# EasyEDA Pro project Cerberus_Sub_Controller_v02.eprj, board Cerberus_Sub_Controller_v02 (continued)
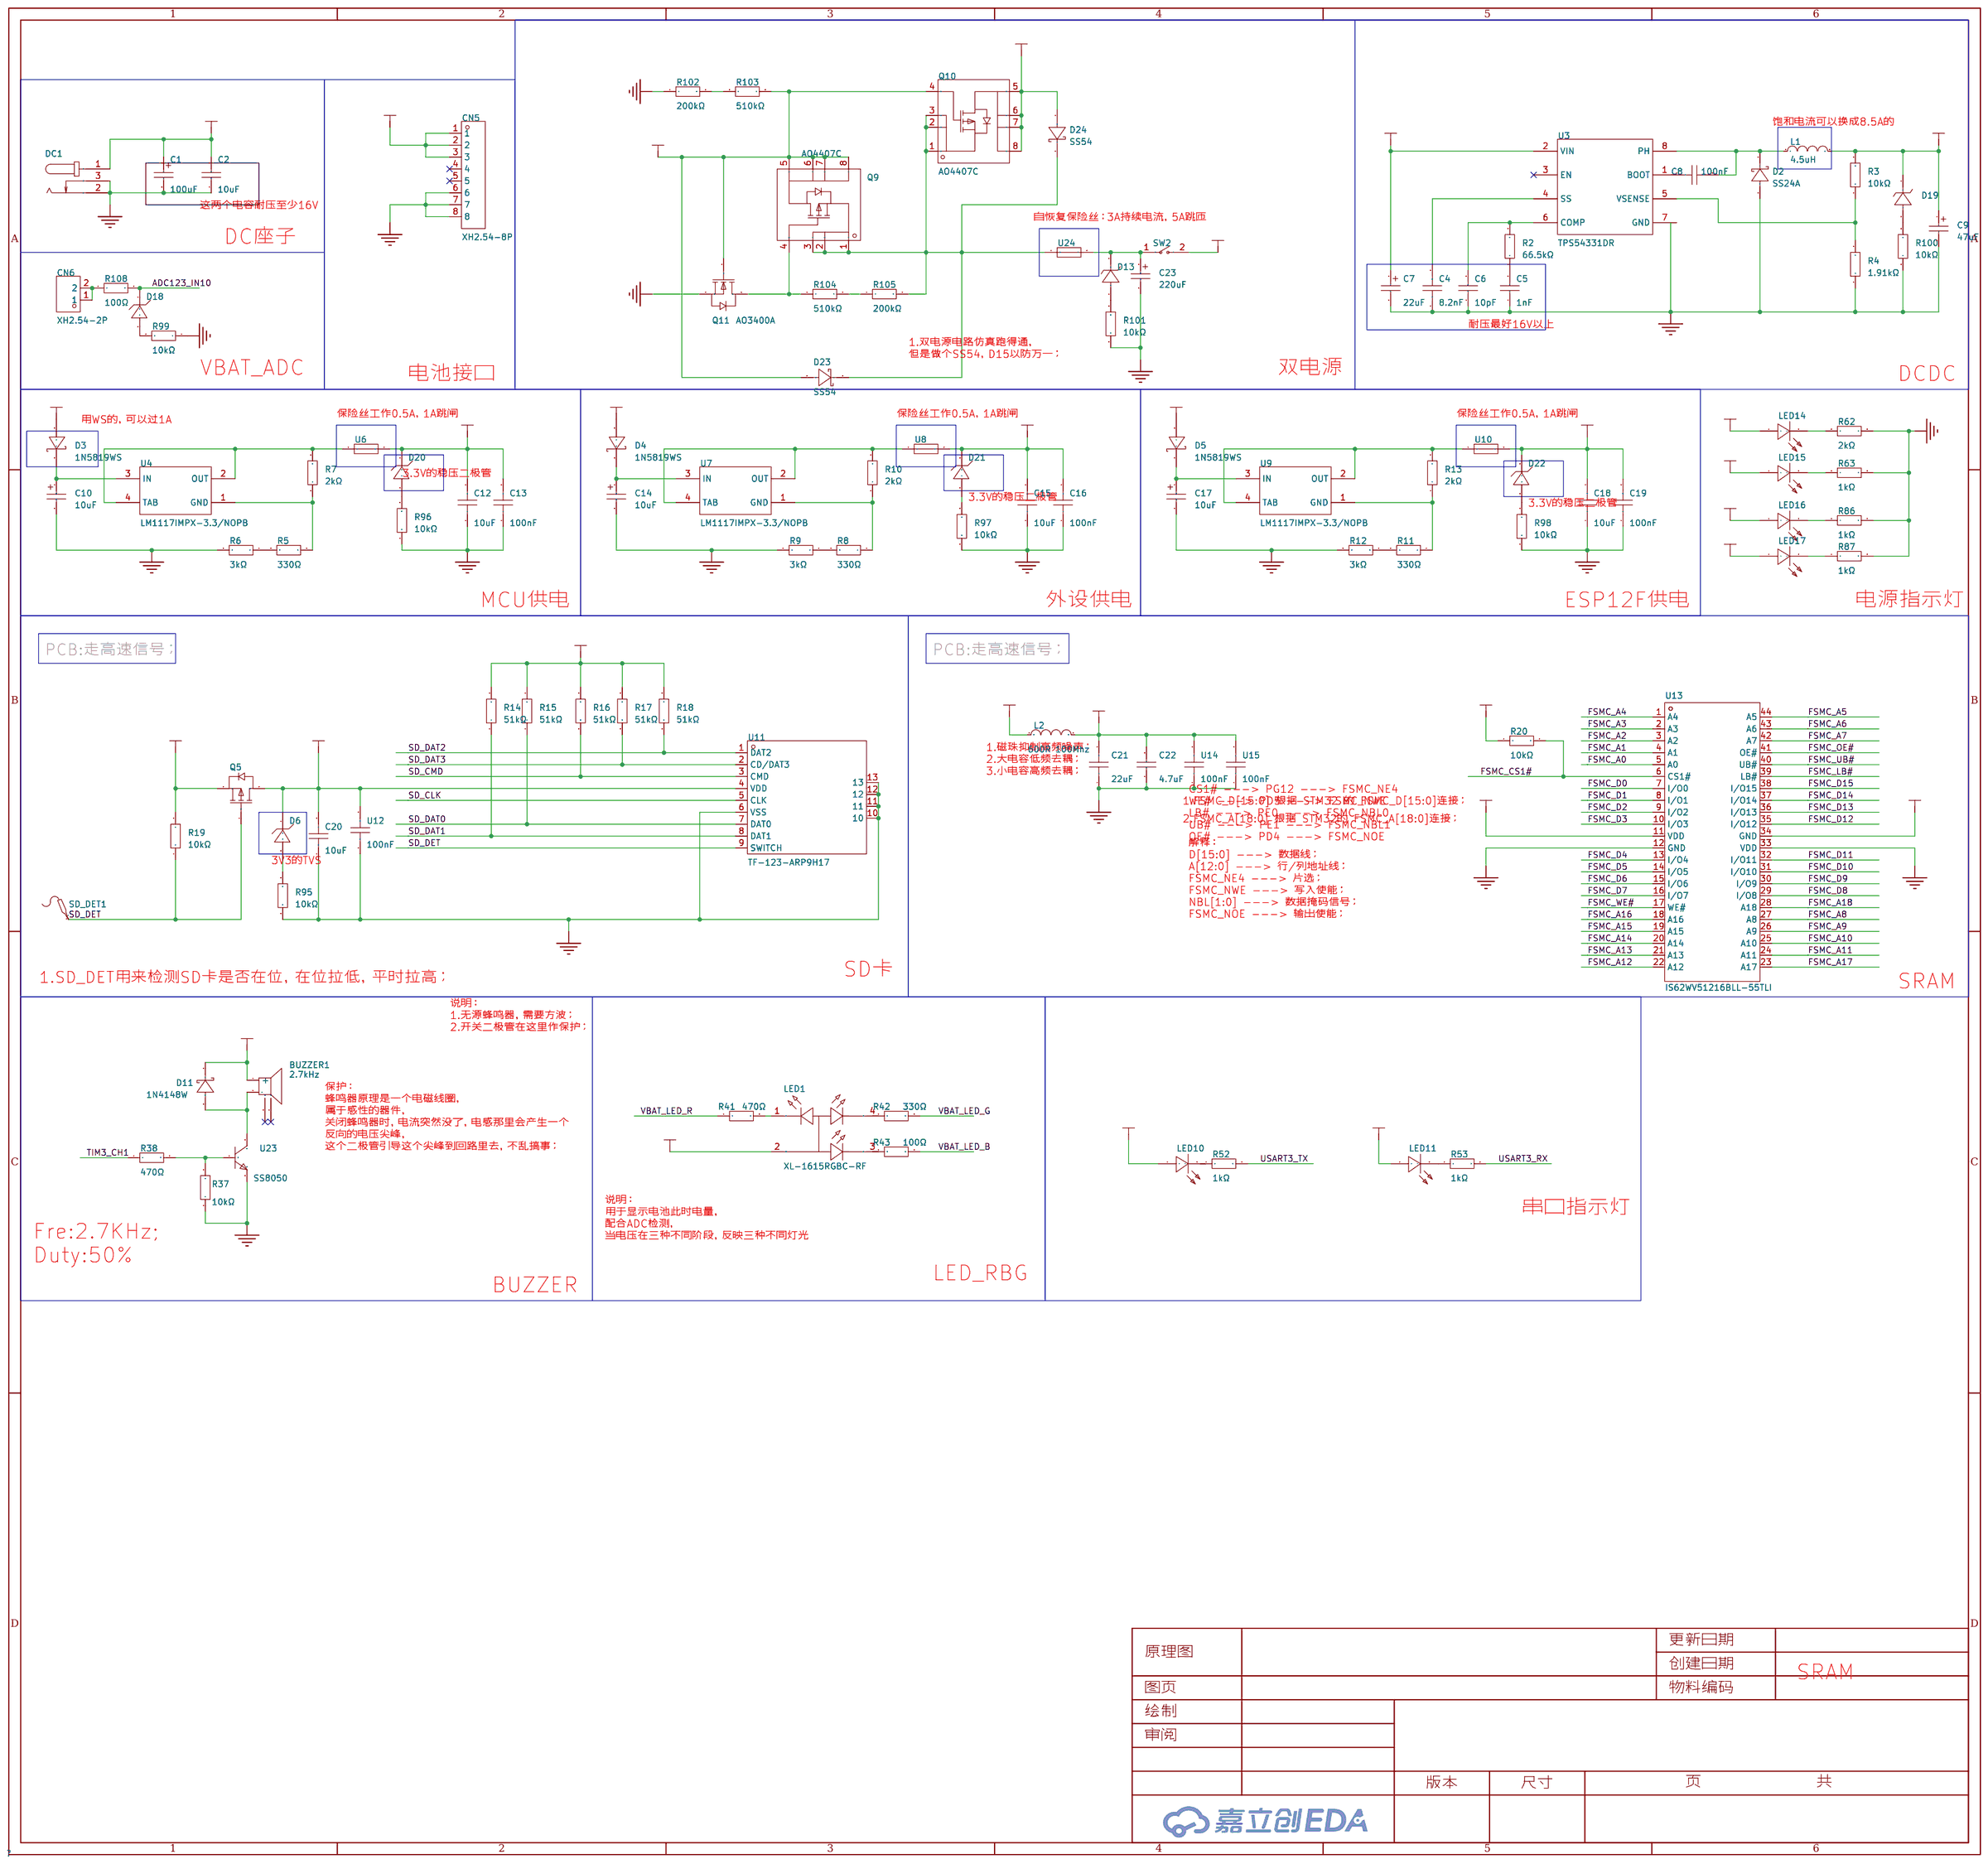
[diagram p0: A1]
## Footprints (pads in the part's own frame, mm; a bottom-side part is the same pattern mirrored in y, then rotated) (continued)
  rect 1.4x1.2 smd: 1(-1.1,-0.875) 2(1.1,-0.875) 3(1.1,0.875) 4(-1.1,0.875)
QFN-24_L4.0-W4.0-P0.50-BL-EP2.7
  oval 0.28x0.8 smd: 1(-1.25,-2) 2(-0.75,-2) 3(-0.25,-2) 4(0.25,-2) 5(0.75,-2) 6(1.25,-2) 13(1.25,2) 14(0.75,2) 15(0.25,2) 16(-0.25,2) 17(-0.75,2) 18(-1.242,2)
  oval 0.8x0.28 smd: 7(2,-1.25) 8(2,-0.75) 9(2,-0.25) 10(2,0.25) 11(2,0.75) 12(2,1.25) 19(-2,1.25) 20(-2,0.75) 21(-2,0.25) 22(-2,-0.25) 23(-2,-0.75) 24(-2,-1.25)
  rect 2.7x2.7 smd: 25(0.013,0)
R0402
  rect 0.566x0.54 smd: 1(-0.433,0) 2(0.433,0)
R0603
  rect 0.806x0.864 smd: 1(-0.753,0) 2(0.753,0)
SMA_L4.3-W2.6-LS5.0-FD
  rect 2.046x1.62 smd: 1(-2.304,-0.009) 2(2.304,0.009)
SMA_L4.4-W2.6-LS5.1-FD
  rect 2x1.62 smd: 1(-2.2,0) 2(2.2,0)
SOD-123_L2.7-W1.6-LS3.7-FD
  rect 0.88x0.96 smd: 1(-1.61,0) 2(1.61,0)
SOD-323_L1.6-W1.3-LS2.7-RD
  rect 0.9x0.7 smd: 1(-1.3,0) 2(1.3,0)
SOD-323_L1.7-W1.3-LS2.6-RD
  rect 0.83x0.63 smd: 1(-1.14,0) 2(1.14,0)
SOD-323_L1.8-W1.3-LS2.5-RD
  rect 1x0.75 smd: 1(-1.173,0) 2(1.173,0)
SOIC-8_L5.0-W4.0-P1.27-LS6.0-BL
  oval 0.569x1.95 smd: 1(-1.905,-2.705) 2(-0.635,-2.705) 3(0.635,-2.705) 4(1.905,-2.705) 5(1.905,2.705) 6(0.635,2.705) 7(-0.635,2.705) 8(-1.905,2.705)
SOP-8_L4.9-W3.9-P1.27-LS6.0-BL
  oval 0.63x1.865 smd: 1(-1.905,-2.683) 2(-0.635,-2.683) 3(0.635,-2.683) 4(1.905,-2.683) 5(1.905,2.683) 6(0.635,2.683) 7(-0.635,2.683) 8(-1.905,2.683)
SOT-23-3_L2.9-W1.3-P1.90-LS2.4-BR
  rect 1.25x0.7 smd: 1(1,-0.95) 2(1,0.95) 3(-1,0)
SOT-223_L6.5-W3.5-P2.30-LS7.0-BR
  rect 2.465x1.05 smd: 1(2.857,-2.3) 2(2.857,0) 3(2.857,2.3)
  rect 2.465x3.54 smd: 4(-2.857,0)
SW-SMD_4P-L4.5-W4.5-P3.00-LS7.0
  rect 1.4x0.9 smd: 1(-3.4,1.5) 2(3.4,1.5) 3(-3.4,-1.5) 4(3.4,-1.5)
SW-SMD_L3.9-W3.0-P4.45
  rect 1.23x1.36 smd: 1(-2.185,0) 2(2.185,0)
SW-TH_2P-L15.0-W10.5-P5.00_KCD11-2P-R
  oval 1.6x5 hole 0.8x4: 1(-2.5,0) 2(2.5,0)
Test-Point-0.5mm
  round 1.27 smd far side: 1(0,0)
TF-SMD_TF-123-ARP9H15
  rect 0.5x1 smd: 1(3.85,-3.092) 2(2.75,-3.092) 3(1.65,-3.092) 4(0.9,-3.092) 5(-0.55,-3.092) 6(-1.65,-3.092) 7(-2.75,-3.092) 8(-3.85,-3.092) 9(0.2,-3.092)
  rect 1.3x1.4 smd: 10(-5.1,-1.357) 11(-5.1,3.092) 12(5.1,3.092) 13(5.1,-1.357)
TSOP-44_L18.4-W10.2-P0.80-LS11.8-BL
  oval 0.448x1.551 smd: 1(-8.4,-5.655) 2(-7.6,-5.655) 3(-6.8,-5.655) 4(-6,-5.655) 5(-5.2,-5.655) 6(-4.4,-5.655) 7(-3.6,-5.655) 8(-2.8,-5.655) 9(-2,-5.655) 10(-1.2,-5.655) 11(-0.4,-5.655) 12(0.4,-5.655) 13(1.2,-5.655) 14(2,-5.655) 15(2.8,-5.655) 16(3.6,-5.655) 17(4.4,-5.655) 18(5.2,-5.655) 19(6,-5.655) 20(6.8,-5.655) 21(7.6,-5.655) 22(8.4,-5.655) 23(8.4,5.655) 24(7.6,5.655) 25(6.8,5.655) 26(6,5.655) 27(5.2,5.655) 28(4.4,5.655) 29(3.6,5.655) 30(2.8,5.655) 31(2,5.655) 32(1.2,5.655) 33(0.4,5.655) 34(-0.4,5.655) 35(-1.2,5.655) 36(-2,5.655) 37(-2.8,5.655) 38(-3.6,5.655) 39(-4.4,5.655) 40(-5.2,5.655) 41(-6,5.655) 42(-6.8,5.655) 43(-7.6,5.655) 44(-8.4,5.655)
USB-C-SMD_TYPE-C-6PIN-2MD-073
  rect 0.55x1.1 smd: 1(-3.2,2.375) 2(-2.4,2.375) 11(2.4,2.375) 12(3.2,2.375)
  rect 0.3x1.1 smd: 3(-1.75,2.375) 4(-1.25,2.375) 5(-0.75,2.375) 6(-0.25,2.375) 7(0.25,2.375) 8(0.75,2.375) 9(1.25,2.375) 10(1.75,2.375)
  oval 1.2x1.8 hole 0.6x1.2: 13(-4.325,-2.375) 14(4.325,-2.375)
  oval 1.1x2 hole 0.6x1.5: 13(-4.325,1.825) 14(4.325,1.825)
WIFIM-SMD_ESP-12F-ESP8266MOD
  rect 1.4x2.5 smd: 1(-7.651,-7.551) 2(-5.651,-7.551) 3(-3.651,-7.551) 4(-1.651,-7.551) 5(0.349,-7.551) 6(2.349,-7.551) 7(4.349,-7.551) 8(6.349,-7.551) 9(6.349,7.548) 10(4.349,7.55) 11(2.349,7.551) 12(0.349,7.551) 13(-1.651,7.55) 14(-3.651,7.551) 15(-5.651,7.551) 16(-7.651,7.551)
  rect 1.7x1.4 smd: 17(7.651,-5) 18(7.649,-3.002) 19(7.649,-1.004) 20(7.649,0.998) 21(7.649,2.997) 22(7.651,4.997)

## Nets
As in the schematic, except:
VCC_5V: +5V.1 C9.1 D3.2 D4.2 D5.2 D19.1 L1.2 R3.2 U22.1
VCC_7V4: 7V4.1 C7.1 SW2.2 U3.2
VCC_MCU_3V3: C3.2 C12.2 C13.2 C34.2 C35.2 C36.2 C37.2 C38.2 C39.2 C40.2 C41.2 C42.2 C43.2 C44.2 C45.2 C46.2 C47.2 C48.2 C49.2 C50.2 C51.2 C59.1 D20.1 H12.1 MCU_3V3#2.1 R39.2 R90.2 U6.2 U31.6 U31.17 U31.30 U31.32 U31.33 U31.39 U31.52 U31.62 U31.71 U31.72 U31.84 U31.95 U31.106 U31.108 U31.121 U31.131 U31.144
VCC_PER_3V3: Battery_led.2 BUZZER.1 C15.2 C16.2 C24.2 C25.1 C27.2 C28.1 C29.1 C31.1 CN3.1 D11.2 D21.1 L2.1 PER_3V3.1 Q5.2 R14.2 R15.2 R16.2 R17.2 R18.2 R19.2 R22.2 R24.2 R26.2 R27.2 R28.2 R70.2 R71.2 R89.1 RX3.1 TX3.1 U1.5 U1.8 U8.2 U16.8 U16.13 U17.9 U17.10 U20.2 U21.2
BOOT0: BOOT0.1 U31.138
ESP_IO0: C52.1 ESP_IO0.1 R80.1 U30.12
ESP_RST: C53.1 ESP_RST.1 R83.1 U30.1
MPU6050_INT: MPU_INT.1 R67.1 U31.22
NRST: 32_NRST.1 C58.1 H12.2 R89.2 U31.25
$1N9180: BUZZER.2 D11.1 U23.3
$1N9349: Battery_led.1 R41.2
$1N9353: Battery_led.3 R43.1
$1N9484: Battery_led.4 R42.1
$1N10259: R52.1 TX3.2
$1N10263: R53.1 RX3.2
$1N12165: 7V4.2 R62.1
$1N12423: +5V.2 R63.1
$1N13016: PER_3V3.2 R86.1
$1N13023: MCU_3V3#2.2 R87.1
$2N7340: C52.2 ESP_IO0.4 R81.2
$2N7398: C53.2 ESP_RST.4 R84.2
$3N7064: MCU_3V3.1 R90.1
$3N7085: GND.1 R91.2
$3N7148: 32_NRST.2 C58.2 R106.1

Pads without a net: BUZZER 3 4; CN3 6; CN5 4 5; ESP_IO0 2 3; ESP_RST 2 3; U1 4; U3 3; U16 2 3 4 5 14 15 16 17 19 21 22; U17 2 11 12; U30 2 4 11 13 14 17 18 19 20 21 22; U31 1 2 3 4 5 7 18 19 20 21 27 28 29 40 41 43 44 45 46 47 49 74 75 76 91 92 97 100 103 110 117 122 123 124 126 128 132 134 136 137; USB1 2 3 9 11

## Via types
v1: diameter 0.45, hole 0.3, Top Layer to Bottom Layer, 1410 vias
v2: diameter 0.61, hole 0.305, Top Layer to Bottom Layer, 38 vias

## Routing (per net, layer and track width the routed paths; a pad name or vN(x,y) marks a point on that pad's centre or on a via; arc(x,y) is an arc through that point)
GND: length 51
  Top Layer w0.203: v1(40.77,43.95) 40.85,44.03 40.85,44.89 U31.16 ; v1(46.99,58.3) 47.57,57.72 47.57,57.11 46.62,56.16 ; v1(26.67,66.36) 26.67,66.14 U31.83 ; 19.68,56.16 18.29,57.55 v1(18.29,57.79) ; U31.61 39.37,65.17 v1(39.37,65.79) ; U31.120 24.26,50.06 v1(24.26,50.42) ; 45.21,51.14 46.1,50.24 v1(46.1,49.79) ; U31.51 43.05,61.79 v1(43.05,62.23) ; U31.130 25.53,44.26 v1(25.53,44.07) ; v1(23.37,62.23) 23.37,61.66 U31.94
  Top Layer w0.254: 43.69,46.23 arc(43.73,46.26) v1(43.75,46.21) arc(43.74,45.57) 43.56,44.96 arc(43.28,44.68) v1(43.04,44.37) arc(42.73,43.8) 42.54,43.18 arc(42.53,43.03) v1(42.56,42.89) arc(42.61,42.77) 42.67,42.68 arc(43.18,42.09) v1(43.72,41.54) arc(44.14,41.15) 44.58,40.77 arc(44.86,40.56) v1(45.16,40.39) arc(46,40.07) v1(46.89,39.98) arc(47.87,40.15) v1(48.76,40.59) arc(48.96,40.74) 49.15,40.9 arc(49.57,41.29) v1(49.98,41.7) arc(50.57,42.32) v1(51.14,42.96) arc(51.29,43.13) 51.44,43.31 arc(51.74,43.78) v1(51.94,44.3) arc(51.99,45.22) v1(51.72,46.1) arc(51.65,46.23) 51.56,46.36 arc(51.14,46.88) v1(50.65,47.34) arc(50,47.8) 49.28,48.14 arc(48.51,48.28) v1(47.75,48.14) arc(47.49,48.03) 47.24,47.88 arc(46.86,47.65) v1(46.46,47.47) arc(45.84,47.3) v1(45.21,47.25)
  Bottom Layer w0.203: 18.05,13.85 v1(18.3,14.1) ; 18.05,13.85 18.04,13.84 U17.6 18.04,11.98 v1(17.74,11.69) ; 18.05,13.85 U17.8 ; U16.11 17.58,23.49 v1(17.7,23.37)
  vias: v1(0.76,91.74) v1(0.76,88.89) v1(0.76,86.17) v1(0.76,83.23) v1(0.76,80.38) v1(0.76,77.66) v1(0.76,74.88) v1(0.76,72.03) v1(0.76,69.31) v1(0.76,66.37) v1(0.76,63.52) v1(0.76,60.8) v1(0.76,57.74) v1(0.76,54.89) v1(0.76,52.17) v1(0.76,49.23) v1(0.76,46.38) v1(0.76,43.66) v1(0.76,40.86) v1(0.76,38.02) v1(0.76,35.3) v1(0.76,32.35) v1(0.76,29.5) v1(0.76,26.78) v1(0.76,23.31) v1(0.76,20.47) v1(0.76,17.75) v1(0.76,14.8) v1(0.76,11.96) v1(0.76,9.24) v1(0.76,6.89) v1(0.75,3.94) v1(1.52,93.49) v1(1.48,1.55) v1(2.11,59.59) v1(2.11,49.39) v1(2.8,71.63) v1(2.8,66.42) v1(3.05,18.16) v1(3.05,14.89) v1(3.05,11.56) v1(3.17,52.14) v1(3.33,0.77) v1(3.36,68.97) v1(3.4,50.3) v1(3.63,26.29) v1(3.68,85.22) v1(3.77,91.32) v1(3.91,62.36) v1(3.94,31.88) v1(3.94,30.48) v1(4.13,94.24) v1(4.32,56.39) v1(4.44,33.02) v1(4.57,58.81) v1(4.97,69.6) v1(4.97,68.4) v1(4.95,28.71) v1(5.08,52.14) v1(5.21,79.63) v1(5.21,77.47) v1(5.42,19.18) v1(5.46,5.97) v1(5.59,81.16) v1(5.84,41.79) v1(5.97,44.2) v1(6.22,39.27) v1(6.22,37.72) v1(6.17,0.77) v1(6.3,26.29) v1(6.48,75.82) v1(6.6,78.11) v1(6.56,59.59) v1(6.56,49.39) v1(6.82,72.17) v1(6.82,65.77) v1(6.87,6.85) v1(6.97,94.24) v1(6.98,79.76) v1(7.37,40.01) v1(7.37,36.71) v1(7.62,62.36) v1(7.75,91.32) v1(7.78,41.79) v1(7.87,85.6) v1(7.87,76.84) v1(7.87,44.2) v1(7.87,38.61) v1(8.13,74.17) v1(8.3,56.14) v1(8.51,78.36) v1(8.64,18.04) v1(8.64,14.86) v1(8.64,11.64) v1(8.59,6.85) v1(8.87,67.19) v1(8.89,0.77) v1(9.02,26.29) v1(9.14,39.75) v1(9.4,42.55) v1(9.53,75.31) v1(9.53,56.65) v1(9.53,51.19) v1(9.69,94.24) v1(9.75,36.71) v1(9.91,47.63) v1(9.86,44.2) v1(10.03,76.84) v1(10.16,40.77) v1(10.42,30.36) v1(10.41,29.09) v1(10.5,6.86) v1(10.54,3.94) v1(10.55,5.1) v1(10.67,74.17) v1(10.8,62.36) v1(10.8,33.41) v1(10.8,31.79) v1(10.92,66.52) v1(10.85,51.19) v1(10.92,48.64) v1(11.18,41.79) v1(11.3,59.32) v1(11.3,57.03) v1(11.51,68.94) v1(11.81,49.41) v1(11.81,44.2) v1(11.81,30.36) v1(11.84,0.77) v1(11.94,74.93) v1(11.89,29.09) v1(12.06,36.71) v1(12.14,3.94) v1(12.19,56.27) v1(12.15,6.86) v1(12.15,5.1) v1(12.45,59.31) v1(12.5,41.48) v1(12.64,94.24) v1(12.57,33.79) v1(12.83,68.2) v1(12.83,25.15) v1(13.21,31.75) v1(13.39,44.2) v1(13.46,49.15) v1(13.46,29.98) v1(13.46,15.79) v1(13.59,73.79) v1(13.59,56.77) v1(13.81,23.25) v1(13.81,21.72) v1(14.1,58.17) v1(14.1,51.69) v1(14.05,22.48) v1(14.22,49.92) v1(14.2,6.86) v1(14.2,5.1) v1(14.16,3.94) v1(14.35,61.09) v1(14.48,36.07) v1(14.61,43.56) v1(14.61,33.02) v1(14.73,15.79) v1(14.68,0.77) v1(14.83,64.76) v1(14.86,50.68) v1(14.86,31.25) v1(15.07,12.07) v1(15.37,28.45) v1(15.49,94.24) v1(15.81,69.85) v1(16,15.79) v1(16.13,27.69) v1(16.24,5.1) v1(16.23,3.94) v1(16.26,9.66) v1(16.25,6.86) v1(17.27,30.36) v1(17.4,72.27) v1(17.4,0.77) v1(17.59,82.06) v1(17.64,66.52) v1(17.75,80.39) v1(17.65,58.42) v1(17.65,53.72) v1(17.7,22.23) v1(18.03,61.98) v1(18.03,29.59) v1(18.05,63.63) v1(18.09,9.28) v1(18.21,94.24) v1(18.29,54.97) v1(18.29,53.15) v1(18.28,22.74) v1(18.42,6.86) v1(18.42,5.34) v1(18.38,3.94) v1(18.54,42.55) v1(18.54,40.39) v1(18.71,25.91) v1(18.8,72.27) v1(18.8,23.37) v1(18.8,22.23) v1(18.8,15.88) v1(19.18,59.31) v1(19.3,34.17) v1(19.3,32.64) v1(19.43,63.63) v1(19.43,61.98) v1(19.56,38.23) v1(19.56,9.28) v1(19.56,7.88) v1(19.69,44.2) v1(19.67,24.74) v1(19.67,20.74) v1(19.73,11.71) v1(19.94,72.65) v1(20.19,0.77) v1(20.32,69.22) v1(20.45,78.87) v1(20.45,77.47) v1(20.45,75.91) v1(20.45,5.85) v1(20.83,92.33) v1(20.83,89.03) v1(20.83,85.35) v1(20.83,82.44) v1(20.83,48.39) v1(20.83,39.25) v1(20.83,38.1) v1(20.78,15.88) v1(20.83,11.71) v1(20.99,94.24) v1(21.08,33.09) v1(21.08,31.75) v1(21.34,45.6) v1(21.34,36.45) v1(21.4,4.26) v1(21.46,25.06) v1(21.46,6.99) v1(21.72,78.87) v1(21.72,77.47) v1(21.72,75.94) v1(21.72,42.17) v1(21.84,67.31) v1(21.84,65.07) v1(21.84,62.36) v1(21.84,9.4) v1(22.22,71.12) v1(22.35,56.39) v1(22.44,53.51) v1(22.61,41.15) v1(22.86,46.99) v1(22.86,8.39) v1(22.92,5.78) v1(22.99,52.33) v1(22.99,11) v1(23.03,0.77) v1(23.11,85.35) v1(23.11,82.42) v1(23.11,37.09) v1(23.24,51.31) v1(23.24,43.69) v1(23.4,92.46) v1(23.37,72.27) v1(23.37,63.38) v1(23.37,57.28) v1(23.46,54.41) v1(23.83,94.24) v1(23.88,51.95) v1(24,9.53) v1(24.13,42.68) v1(24.32,7.18) v1(24.38,58.3) v1(24.51,30.1) v1(24.64,73.54) v1(24.64,45.09) v1(24.77,89.03) v1(25.15,41.03) v1(25.27,49.41) v1(25.27,8.51) v1(25.53,52.58) v1(25.58,54.29) v1(25.65,56.65) v1(25.75,0.77) v1(25.91,74.81) v1(25.89,33.91) v1(25.91,28.58) v1(26.03,40.14) v1(26.03,13.21) v1(26.03,11.36) v1(26.03,9.91) v1(26.16,48.52) v1(26.23,31.51) v1(26.29,55.38) v1(26.29,53.47) v1(26.29,51.19) v1(26.42,92.46) v1(26.54,60.2) v1(26.56,94.24) v1(26.67,67.69) v1(26.67,42.55) v1(26.8,37.34) v1(27.06,57.53) v1(27.18,76.2) v1(27.18,30.1) v1(27.18,13.32) v1(27.18,11.31) v1(27.31,8.51) v1(27.43,61.22) v1(27.43,51.44) v1(27.53,55.85) v1(27.53,54.29) v1(27.54,52.96) v1(27.54,33.91) v1(27.56,41.66) v1(27.56,27.06) v1(27.56,9.78) v1(27.81,49.41) v1(27.81,12.58) v1(27.94,83.19) v1(28.07,58.55) v1(28.07,24.06) v1(28.07,22.6) v1(28.07,20.71) v1(28.32,68.71) v1(28.32,38.87) v1(28.26,31.51) v1(28.45,62.23) v1(28.7,77.73) v1(28.7,50.3) v1(28.7,0.77) v1(29.04,92.51) v1(28.95,57.41) v1(28.95,55.83) v1(28.95,54.29) v1(28.96,52.96) v1(28.96,28.33) v1(29.19,35.29) v1(29.22,17.78) v1(29.5,94.24) v1(29.46,84.59) v1(29.46,11.43) v1(29.59,26.99) v1(29.59,24.06) v1(29.59,22.59) v1(29.59,20.71) v1(29.72,69.73) v1(29.67,51.31) v1(29.72,40.26) v1(29.72,33.91) v1(29.72,12.58) v1(29.85,47.76) v1(29.85,9.28) v1(29.89,8.26) v1(29.97,79) v1(29.97,53.85) v1(30.14,57.66) v1(30.1,19.4) v1(30.15,59.44) v1(30.22,4.83) v1(30.35,56.14) v1(30.61,51.31) v1(30.67,31.49) v1(30.99,80.01) v1(31.01,70.72) v1(31.14,89.11) v1(31.12,61.59) v1(31.24,55.12) v1(31.5,22.23) v1(31.54,0.77) v1(31.62,51.06) v1(31.62,49.65) v1(31.62,48.18) v1(31.62,46.7) v1(31.62,45.6) v1(31.62,8.26) v1(31.75,11.31) v1(31.9,71.61) v1(31.88,69.85) v1(31.88,65.41) v1(31.86,33.91) v1(31.89,16.34) v1(32,59.44) v1(32,57.66) v1(32.12,14.74) v1(32.22,9.28) v1(32.35,94.24) v1(32.26,12.7) v1(32.38,53.72) v1(32.38,28.71) v1(32.68,66.59) v1(32.77,56.65) v1(32.89,70.87) v1(33.04,72.75) v1(33.02,65.02) v1(33.47,87.29) v1(33.53,52.84) v1(33.53,45.34) v1(33.72,31.49) v1(33.78,46.61) v1(34.04,55.38) v1(34.04,33.91) v1(34.04,12.7) v1(34.04,11.44) v1(34.1,22.48) v1(34.07,9.28) v1(34.16,73.16) v1(34.16,71.76) v1(34.16,57.92) v1(34.16,14.74) v1(34.29,42.93) v1(34.26,0.77) v1(34.42,59.69) v1(34.42,53.6) v1(34.54,45.85) v1(34.92,61.59) v1(35.07,94.24) v1(35.19,54.29) v1(35.56,56.77) v1(35.56,44.33) v1(35.62,31.5) v1(35.62,29.47) v1(35.61,27.06) v1(35.61,24.01) v1(35.57,21.34) v1(35.57,18.29) v1(35.56,15.62) v1(35.72,73.16) v1(35.73,71.76) v1(35.69,38.87) v1(35.69,37.53) v1(35.69,35.38) v1(35.69,34.1) v1(36.07,60.58) v1(36.07,58.73) v1(36.13,55.18) v1(36.24,92.51) v1(36.19,87.76) v1(36.19,84.84) v1(36.45,69.6) v1(36.96,40.64) v1(36.96,38.87) v1(36.96,36.83) v1(36.96,34.06) v1(36.96,31.5) v1(36.96,29.47) v1(36.96,27.06) v1(36.96,24.01) v1(36.96,21.34) v1(36.96,18.29) v1(37.16,56.21) v1(37.21,50.42) v1(37.35,73.16) v1(37.33,0.77) v1(37.36,71.76) v1(37.46,48.9) v1(37.6,19.42) v1(37.72,70.74) v1(38.13,94.24) v1(38.1,51.31) v1(38.1,49.79) v1(38.61,71.76) v1(38.74,73.41) v1(38.9,57.96) v1(38.86,50.42) v1(38.88,20.69) v1(38.99,84.46) v1(39.37,74.3) v1(39.5,85.74) v1(39.62,79.12) v1(39.62,51.19) v1(39.62,42.68) v1(39.75,48.52) v1(39.81,31.51) v1(39.85,34.86) v1(39.92,13.59) v1(39.89,4.96) v1(40.13,66.55) v1(40.08,1.91) v1(40.17,0.77) v1(40.39,51.95) v1(40.64,83.95) v1(40.64,49.41) v1(40.58,30.29) v1(40.64,9.28) v1(40.77,41.91) v1(40.89,39.37) v1(40.97,94.24) v1(41.15,52.71) v1(41.1,10.67) v1(41.4,50.17) v1(41.65,22.48) v1(41.6,1.91) v1(41.85,31.51) v1(42.04,50.93) v1(41.97,28.9) v1(42.07,79.76) v1(42.16,53.6) v1(42.31,90.43) v1(42.29,68.71) v1(42.54,84.97) v1(42.54,13.59) v1(42.51,9.53) v1(42.54,4.96) v1(42.89,0.77) v1(43.02,1.91) v1(43.05,81.54) v1(43.12,30.42) v1(43.13,10.67) v1(43.18,54.75) v1(43.44,38.48) v1(43.5,27.37) v1(43.56,88.14) v1(43.56,69.98) v1(43.69,94.24) v1(44.16,86.36) v1(44.2,79.76) v1(44.2,55.76) v1(44.32,63.38) v1(44.26,31.49) v1(44.34,1.91) v1(44.51,29.02) v1(44.7,83.06) v1(44.7,22.48) v1(44.83,42.81) v1(45.09,48.77) v1(45.34,71.76) v1(45.47,84.38) v1(45.72,64.77) v1(45.85,90.43) v1(45.84,0.77) v1(45.91,1.91) v1(45.97,86.36) v1(46.04,33.09) v1(46.19,10.67) v1(46.17,9.53) v1(46.29,24.96) v1(46.35,30.48) v1(46.64,94.24) v1(46.6,13.85) v1(46.74,65.79) v1(46.69,4.96) v1(47.24,81.79) v1(47.18,37.28) v1(47.33,1.91) v1(47.43,26.1) v1(47.56,34.61) v1(47.69,23.56) v1(48.01,59.69) v1(48.01,32.14) v1(48.13,9.53) v1(48.2,10.67) v1(48.26,52.71) v1(48.37,83.06) v1(48.7,38.8) v1(48.68,0.77) v1(48.83,24.71) v1(48.84,1.91) v1(49.02,60.71) v1(48.96,36.01) v1(49.15,48.14) v1(49.21,22.04) v1(49.41,46.1) v1(49.49,94.24) v1(49.53,70.62) v1(49.53,54.61) v1(49.53,51.32) v1(49.78,89.16) v1(49.78,87.68) v1(49.91,61.47) v1(50.07,82.08) v1(50.1,40.2) v1(50.16,55.63) v1(50.16,37.47) v1(50.16,26.29) v1(50.16,13.85) v1(50.16,10.67) v1(50.16,9.53) v1(50.29,69.85) v1(50.29,58.3) v1(50.42,50.43) v1(50.36,23.18) v1(50.42,4.96) v1(50.42,1.91) v1(50.67,62.23) v1(50.67,34.29) v1(50.8,90.56) v1(50.8,79.76) v1(51.05,78.24) v1(51.05,77.25) v1(51.18,76.2) v1(51.31,71.76) v1(51.31,56.77) v1(51.44,88.4) v1(51.44,59.44) v1(51.4,0.77) v1(51.56,63.12) v1(51.69,80.52) v1(51.69,79) v1(51.69,38.99) v1(51.82,28.07) v1(51.94,70.87) v1(52.21,94.24) v1(52.2,76.97) v1(52.32,57.66) v1(52.39,21.4) v1(52.45,79.76) v1(52.45,71.76) v1(52.45,64.01) v1(52.45,60.46) v1(52.6,74.93) v1(52.58,54.61) v1(52.71,81.79) v1(52.83,87.13) v1(52.76,16.13) v1(53.09,47.25) v1(53.09,45.72) v1(53.09,44.29) v1(53.09,42.79) v1(53.09,41.19) v1(53.09,39.28) v1(53.09,37.5) v1(53.09,35.99) v1(53.21,77.86) v1(53.34,82.43) v1(53.34,58.68) v1(53.34,55.5) v1(53.34,53.6) v1(53.59,83.44) v1(53.59,61.6) v1(53.78,20.01) v1(54.01,81.24) v1(53.97,50.17) v1(53.97,49.15) v1(54.1,80.14) v1(54.1,78.62) v1(54.2,0.77) v1(54.48,33.3) v1(54.48,32.14) v1(54.48,30.59) v1(54.48,29.19) v1(54.48,27.5) v1(54.48,24.13) v1(54.48,4.96) v1(54.74,22.99) v1(54.86,51.95) v1(54.86,11.94) v1(54.86,9.65) v1(54.86,7.51) v1(55.01,94.24) v1(54.99,57.28) v1(55.12,2.8) v1(55.31,18.48) v1(55.5,59.44) v1(55.5,58.36) v1(55.5,5.97) v1(55.83,78.93) v1(55.89,85.56) v1(55.89,84.31) v1(55.89,82.67) v1(55.88,51.19) v1(56.01,90.68) v1(56.01,21.59) v1(56.03,11.97) v1(56.03,9.66) v1(56.03,7.49) v1(56.26,64.27) v1(56.26,60.33) v1(56.26,57.19) v1(56.39,46.87) v1(56.39,45.61) v1(56.39,44.08) v1(56.39,42.69) v1(56.39,41.17) v1(56.39,39.8) v1(56.39,38.38) v1(56.39,36.77) v1(56.39,35.32) v1(56.39,33.76) v1(56.39,32.09) v1(56.39,30.53) v1(56.39,29.19) v1(56.39,25.79) v1(56.39,24.21) v1(57.02,75.06) v1(57.02,61.22) v1(57.05,0.77) v1(57.15,20.45) v1(57.4,23.12) v1(57.69,87.93) v1(57.66,65.54) v1(57.85,94.24) v1(57.9,78) v1(58.04,86.49) v1(58.04,85.15) v1(58.04,83.7) v1(58.07,74.08) v1(58.55,22.1) v1(58.67,25.78) v1(58.8,66.68) v1(59.17,79.39) v1(59.69,21.09) v1(59.77,0.77) v1(60.57,94.24) v1(60.58,64.39) v1(60.58,14.11) v1(60.58,12.07) v1(60.71,67.31) v1(61.15,68.97) v1(61.06,30.68) v1(61.06,27.02) v1(61.06,23.37) v1(61.72,92.46) v1(61.72,89.23) v1(61.72,86.75) v1(61.72,64.77) v1(62.36,10.69) v1(62.36,8.26) v1(62.61,65.54) v1(62.72,0.77) v1(63.12,68.33) v1(63.52,94.24) v1(63.5,71.5) v1(63.63,66.68) v1(63.75,30.68) v1(63.75,27.02) v1(63.75,23.37) v1(63.75,19.94) v1(63.75,16.51) v1(63.94,5.47) v1(63.92,2.67) v1(64.09,86.75) v1(64.52,81.54) v1(64.77,72.65) v1(65.15,67.95) v1(65.53,80.56) v1(65.53,79.25) v1(65.53,77.92) v1(65.53,76.65) v1(65.53,75.31) v1(65.56,0.77) v1(65.79,71) v1(66.19,30.68) v1(66.19,27.02) v1(66.19,23.37) v1(66.19,19.94) v1(66.19,16.51) v1(66.29,74.17) v1(66.36,94.24) v1(66.8,86.75) v1(66.8,82.94) v1(66.8,72.01) v1(66.8,69.47) v1(66.8,65.66) v1(67.82,75.7) v1(67.82,73.03) v1(68.01,32.14) v1(68.07,71) v1(68.28,0.77) v1(68.86,90.62) v1(69.08,94.24) v1(69.09,74.3) v1(69.09,72.01) v1(69.22,77.09) v1(69.34,69.06) v1(69.34,65.71) v1(69.34,63.12) v1(69.6,89.41) v1(69.6,87.89) v1(69.6,86.37) v1(69.6,84.81) v1(69.6,83.24) v1(69.6,81.69) v1(69.6,79.91) v1(69.63,5.47) v1(69.63,2.67) v1(69.73,41.03) v1(70.1,52.45) v1(70.23,73.03) v1(70.36,75.57) v1(71.37,90.68) v1(71.37,89.41) v1(71.37,87.94) v1(71.37,86.37) v1(71.37,84.79) v1(71.37,83.32) v1(71.37,81.72) v1(71.37,79.95) v1(71.37,71.63) v1(71.44,32.14) v1(71.63,77.09) v1(71.63,74.3) v1(71.63,56.9) v1(71.75,45.6) v1(71.75,0.77) v1(71.88,34.61) v1(72.56,94.24) v1(72.68,35.53) v1(72.9,54.65) v1(72.9,52.45) v1(72.93,46.61) v1(72.9,41.03) v1(73.03,75.57) v1(73.03,69.63) v1(73.03,43.18) v1(73.06,57.92) v1(73.41,79) v1(73.66,73.66) v1(73.66,71.63) v1(74.17,35.63) v1(74.17,32.2) v1(74.55,77.09) v1(74.6,0.77) v1(74.93,80.39) v1(75.31,20.5) v1(75.31,16.85) v1(75.31,13.42) v1(75.31,9.99) v1(75.4,94.24) v1(75.44,5.47) v1(75.44,2.67) v1(75.98,73.78) v1(76.2,75.95) v1(76.16,71.63) v1(76.33,35.63) v1(76.33,32.2) v1(76.58,82.05) v1(76.58,79) v1(77.32,0.77) v1(77.44,20.45) v1(77.98,58.55) v1(77.98,57.41) v1(77.98,56.12) v1(78.12,94.24) v1(78.1,85.17) v1(78.1,83.57) v1(78.1,80.39) v1(78.3,13.97) v1(78.28,12.83) v1(78.36,79.12) v1(78.36,77.43) v1(78.36,9.7) v1(78.36,6.06) v1(78.36,2.62) v1(78.46,73.78) v1(78.46,71.63) v1(78.61,49.45) v1(78.61,45.81) v1(78.61,42.9) v1(78.61,38.95) v1(78.61,35.63) v1(78.61,32.2) v1(79.25,13.97) v1(79.25,12.83) v1(79.5,82.05) v1(80.14,85.22) v1(80.23,31.63) v1(80.26,0.77) v1(80.39,42.17) v1(80.39,40.01) v1(80.77,53.63) v1(80.77,52.71) v1(81.03,83.57) v1(80.98,36.58) v1(81,34.8) v1(81.07,94.24) v1(81.09,18.93) v1(81.29,48.23) v1(81.28,47.25) v1(81.42,79.12) v1(81.42,77.47) v1(82.17,36.58) v1(82.17,34.8) v1(82.34,85.22) v1(82.3,42.17) v1(82.3,40.01) v1(82.57,22.42) v1(82.93,76.07) v1(83.08,71.5) v1(83.11,0.77) v1(83.69,79.12) v1(83.69,77.47) v1(83.91,94.24) v1(84.75,82.1) v1(84.96,57.32) v1(85.83,0.77) v1(86.63,94.24) v1(86.72,71.5) v1(87.12,64.38) v1(87.69,55.12) v1(88.18,0.77) v1(88.73,90.49) v1(88.73,87.91) v1(88.73,85.12) v1(88.73,82.1) v1(88.98,94.24) v1(89.28,53.28) v1(89.4,68.58) v1(89.39,67.31) v1(90.15,71.5) v1(90.42,68.58) v1(90.42,67.31) v1(91,57.28) v1(91.12,0.76) v1(91.69,90.49) v1(91.69,87.79) v1(91.69,85.09) v1(91.69,82.05) v1(91.93,94.23) v1(92.07,69.07) v1(92.07,65.43) v1(92.07,62) v1(92.17,49.31) v1(92.17,45.67) v1(92.17,42.24) v1(93.51,93.49) v1(93.49,1.51) v1(94.24,91.06) v1(94.23,88.12) v1(94.23,85.77) v1(94.23,83.05) v1(94.23,80.2) v1(94.23,77.26) v1(94.23,74.53) v1(94.23,71.69) v1(94.23,68.22) v1(94.23,65.5) v1(94.23,62.65) v1(94.23,59.71) v1(94.23,56.99) v1(94.23,54.14) v1(94.23,51.34) v1(94.23,48.62) v1(94.23,45.78) v1(94.23,42.83) v1(94.23,40.11) v1(94.23,37.27) v1(94.23,34.2) v1(94.23,31.48) v1(94.23,28.64) v1(94.23,25.69) v1(94.23,22.97) v1(94.23,20.13) v1(94.23,17.34) v1(94.23,14.62) v1(94.23,11.78) v1(94.23,8.83) v1(94.23,6.11) v1(94.23,3.27) v2(45.47,44.33) v2(48.39,44.74) v2(58.04,61.18) v2(59.06,42.23) v2(59.69,61.03) v2(60.2,53.85) v2(60.96,42.23) v2(61.59,61.03) v2(62.1,53.85) v2(63.63,33.5) v2(63.88,56.11) v2(64.01,44.72)
VBAT_LED_B: length 23.6
  Top Layer w0.203: R43.2 9.43,30.86 11.43,30.86 19.94,39.37 19.94,39.38 U31.129
VBAT_LED_G: length 26
  Top Layer w0.203: v1(20.32,40.77) 20.32,42.59 U31.125 ; v1(19.94,37.47) 12.19,29.72 9.39,29.72 R42.2
  Bottom Layer w0.203: v1(20.32,40.77) 20.32,37.85 v1(19.94,37.47)
VBAT_LED_R: length 39.8
  Top Layer w0.203: 24.63,61.11 28.32,57.42 v1(28.32,57.41) ; R41.1 12.57,32.77 19.69,39.88 19.69,42.93 v1(19.94,43.18)
  Bottom Layer w0.203: v1(28.32,57.41) 28.32,51.57 v1(19.94,43.18)
VCC_5V: length 33.6
  Top Layer w0.508: U22.1 84.27,84.65 80.26,80.65 80.26,68.76 v1(80.05,68.54) ; L1.2 v1(85.37,64.97) 89.53,60.8 R3.2
  vias: v1(74.07,60.96) v1(74.07,49.53) v1(74.07,38.48) v1(75.43,68.54) v1(75.43,66.51) v1(75.43,64.48) v1(75.43,62.45) v1(75.44,60.2) v1(75.44,58.17) v1(75.44,56.14) v1(75.44,54.11) v1(75.44,52.2) v1(75.44,50.17) v1(75.44,48.14) v1(75.44,46.11) v1(75.44,43.84) v1(75.44,41.81) v1(75.44,40.16) v1(75.44,38.64) v1(76.57,68.54) v1(76.57,66.51) v1(76.57,64.48) v1(76.57,62.45) v1(76.58,60.2) v1(76.58,58.17) v1(76.58,56.14) v1(76.58,54.11) v1(76.58,52.2) v1(76.58,50.17) v1(76.58,48.14) v1(76.58,46.11) v1(76.58,43.84) v1(76.58,41.81) v1(76.58,40.16) v1(76.58,38.64) v1(78.45,68.54) v1(78.45,67.38) v1(78.45,66.28) v1(78.45,64.97) v1(80.05,67.38) v1(80.05,66.28) v1(80.05,64.97) v1(81.65,68.54) v1(81.65,67.38) v1(81.65,66.28) v1(81.65,64.97) v1(83.38,68.54) v1(83.38,67.38) v1(83.38,66.28) v1(83.38,64.97) v1(85,68.54) v1(85,67.38) v1(85,66.28)
VCC_7V4: length 6.1
  Bottom Layer w0.508: SW2.2 80.89,44.67 7V4.1
  vias: v1(84.96,51.91) v1(84.96,50.28) v1(84.96,49.1) v1(84.96,47.98) v1(84.96,47.02) v1(85.09,53.22) v1(85.98,48.62) v1(85.98,47.5) v1(85.98,46.16) v1(86.87,48.62) v1(86.87,47.5) v1(86.87,46.16) v1(87.94,48.62) v1(87.94,47.5) v1(87.94,46.16) v1(88.9,48.62) v1(88.9,47.5) v1(88.9,46.16)
VCC_BAT_7V4:
  vias: v1(73.73,28.58) v1(73.73,27.31) v1(73.73,26.04) v1(73.73,24.77) v1(74.91,28.58) v1(74.91,27.31) v1(74.91,26.04) v1(74.91,24.77) v1(75.98,28.58) v1(75.98,27.31) v1(75.98,26.04) v1(75.98,24.77) v1(77.07,28.58) v1(77.07,27.31) v1(77.07,26.04) v1(77.07,24.77)
VCC_DC_7V4: length 8.6
  Bottom Layer w0.508: 82.57,20.52 82.5,20.45 80.52,20.45 80.14,20.83 80.14,24.39 80.52,24.77 Q10.4
  vias: v1(82.49,18.93) v1(82.57,20.45) v1(82.87,17.5) v1(82.87,16.58) v1(83.69,16.9) v1(84.96,16.12) v1(84.96,14.81) v1(84.96,13.59) v1(84.96,12.2) v1(86.23,16.12) v1(86.23,14.86) v1(86.23,13.59) v1(86.23,12.2) v1(87.5,16.12) v1(87.51,14.86) v1(87.5,13.59) v1(87.5,12.2) v1(88.77,16.12) v1(88.77,14.86) v1(90.53,16.91) v1(90.53,15.82) v1(90.55,14.86) v1(91.82,16.91) v1(91.84,15.82)
VCC_ESP_3V3: length 72.3
  Inner2 w0.381: 37.97,18.29 36.86,17.18 v1(26.67,17.18)
  Inner2 w0.508: v1(33.11,7.64) 34.78,7.64 v1(34.8,7.66) 41.82,7.66 45.21,11.05 45.21,18.8
  Inner2 w1.27: 59.06,40.52 59.06,30.23 48.64,19.82 40.09,19.82 v1(39.84,19.56) 38.35,18.08 v1(38.35,16.13) v1(37.08,16.13)
  vias: v1(38.59,18.43) v2(59.06,40.71) v2(60.96,40.64) v2(63.63,39.75) v2(65.91,39.75)
VCC_FSMC_3V3: length 17.9
  Inner2 w0.508: v1(50.67,82.55) 47.24,85.98 47.24,87
  Bottom Layer w0.508: U15.2 54.61,79.38 53.85,79.38 v1(50.67,82.55) ; 56.91,78.98 56.37,78.44 56.37,77.72 58.64,75.45 v1(58.64,74.65)
  vias: v1(47.35,86.97)
VCC_MCU_3V3: length 193.3
  Top Layer w0.254: v1(29.08,46.99) 28.96,46.99 U31.131 ; U31.30 42.93,52.71 v1(42.93,52.83) ; 45.56,51.49 47.26,49.79 v1(47.37,49.79) ; v1(33.79,65.79) 33.78,65.8 33.78,66.66 U31.71 ; v1(30.35,62.37) 30.34,62.36 29.74,62.36 U31.84 ; U31.33 47.21,50.55 C49.2 ; v1(22.69,55.18) 21.37,55.18 U31.106 ; U31.62 35.85,62.37 v1(35.69,62.37) ; U31.121 25.32,50.42 v1(25.52,50.42) ; v1(38.19,48.18) 38.27,48.18 40.26,46.19 ; v1(21.71,54.24) 20.89,54.24 19.33,55.81 ; v1(43.95,53.97) 43.95,54.19 U31.39 ; 41.67,61.11 39.63,59.07 v1(39.63,58.68) ; U31.6 34.29,44.38 v1(34.29,44.58) ; U31.72 33.74,67.32 v1(33.41,67.32) ; U31.144 31.77,40.53 v1(33.27,42.04) ; 23.92,60.4 26.02,58.3 v1(26.28,58.3)
  Top Layer w0.381: v1(49.65,49.66) C49.2
  Top Layer w0.762: v1(18.67,46.36) 18.6,46.29 v1(12.71,46.29)
  Inner2 w0.381: v1(64.42,69.54) 64.42,63.02 64.26,62.87
  Inner2 w0.508: v1(33.27,42.04) 33.27,39.37 v1(32.41,38.51)
  Inner2 w0.762: 35.95,62.37 v1(35.69,62.37) ; 35.95,62.37 34.36,63.95 ; 35.95,62.37 v1(39.63,58.68) 43.09,58.68 45.76,56.01 ; v1(33.41,67.32) 33.79,66.94 v1(33.79,65.79) 33.79,64.52 34.36,63.95 ; 30.35,62.36 31.94,63.95 34.36,63.95 ; v1(33.27,42.04) 33.27,42.67 28.95,46.99 ; 28.95,46.99 v1(29.08,46.99) ; 28.95,46.99 v1(25.52,50.42) 24.69,51.25 24.69,57.19 ; v1(30.35,62.37) v1(26.28,58.3) 25.81,58.3 24.69,57.19 ; 24.69,57.19 v1(22.69,55.18) 22.66,55.18 v1(21.71,54.24) 18.67,51.19 v1(18.67,46.36) ; v2(58.04,62.27) 56.17,62.27 54.23,60.33 54.23,52.58 51.18,49.53 49.78,49.53 v1(49.65,49.66) ; v1(34.29,44.58) 34.59,44.58 v1(38.19,48.18) 42.84,52.83 v1(42.93,52.83) 42.93,52.96 v1(43.95,53.97) 53.03,63.06 ; H12.1 3.86,46.29 v1(12.71,46.29)
  Inner2 w1.778: 58.42,62.87 53.21,62.87
  Bottom Layer w0.254: v1(47.37,49.79) 47.5,49.66 v1(49.65,49.66)
  Bottom Layer w0.381: v1(49.65,49.66) C49.2
  vias: v2(59.69,62.43) v2(61.59,62.49) v2(63.88,62.61) v2(66.29,62.61)
VCC_PER_3V3: length 313.1
  Top Layer w0.203: v1(11.05,25.15) 10.47,24.57 R89.1
  Top Layer w0.508: v1(32,91.01) R26.2 ; v1(34.8,91.05) R27.2
  Inner2 w0.254: v1(15.06,13.34) 11.56,13.34
  Inner2 w0.381: 58.42,52.84 58.42,55.58 v1(58.47,55.64)
  Inner2 w0.508: 16.26,63.63 13.46,63.63 12.19,64.9 12.19,66.68 ; v1(21.92,11.92) 21.92,11.76 20.83,10.67 12.45,10.67 11.05,12.07 11.05,20.07 ; 11.68,14.7 v1(13.46,14.7) v1(14.73,14.7) v1(16,14.7) ; 15.11,54.52 v1(10.21,54.52) ; v1(14.9,21.72) 14.9,20.36 14.1,19.56 11.56,19.56 11.05,20.07 ; v1(5.19,57.34) 6.53,57.34 v1(6.73,57.15) 6.73,58.46 v1(8.38,60.11) 8.42,60.07 v1(10.03,60.07) 15.11,60.07 ; v1(14.24,65.92) 12.95,65.92 12.19,66.68 ; v1(60.36,82.85) 60.36,90.64 58.93,92.08 42.04,92.08 35.05,85.09 31.75,85.09 29.46,82.81 v1(29.46,81.53) ; v1(29.46,81.53) 27.05,81.53 ; v1(29.46,81.53) 29.97,82.04 36.34,82.04 v1(36.99,81.39) ; 14.99,34.8 6.35,34.8 5.72,34.17 v1(5.72,30.93) ; 11.05,20.07 v1(11.05,25.15) 17.14,31.25 ; 12.19,66.68 12.19,69.09 12.83,69.73 v1(14.41,69.73) ; v1(37.72,90.33) 37,91.05 v1(34.8,91.05) 34.76,91.01 v1(32,91.01) 30.68,91.01 30.1,90.43 30.1,89.15 v1(30.14,89.11) ; v1(17.62,25.91) 17.62,27.14 19.24,28.77
  Inner2 w1.778: 16.26,63.63 16.26,33.66 24.38,25.53 44.7,25.53 54.36,35.18 54.36,47.25 58.55,51.44 ; 23.24,74.05 16.26,67.06 16.26,63.76 ; 23.24,74.05 25.4,76.2 25.4,83.32 28.57,86.49 ; 23.24,74.05 16.38,74.05 11.4,79.03 11.4,84.71 v1(13.25,84.71)
  Bottom Layer w0.254: v1(14.9,21.72) 15.49,21.72 15.76,21.99 U16.8 ; v1(17.62,25.91) 17.04,25.33 U16.13
  vias: v1(11.05,85.09) v1(11.05,84.08) v1(11.81,54.48) v1(11.93,85.09) v1(11.92,84.08) v1(13.46,54.48) v1(24.38,25.44) v1(26.29,25.4) v1(28.19,89.54) v1(28.19,88.52) v1(28.93,88.52) v1(28.98,89.54) v2(60.2,52.39) v2(62.1,52.39) v2(64.01,51.47) v2(66.17,51.31)
VCC_SD_3V3: length 8
  Top Layer w0.381: v1(6.86,53.5) 6.82,53.54 U12.2 C20.2 3.19,53.55 Q5.3
  Bottom Layer w0.381: v1(6.86,53.5) 6.94,53.59 8.3,53.59
ADC123_IN10: length 57.8
  Top Layer w0.203: v1(42.93,51.69) 42.54,51.31 42.54,50.27 U31.26 ; v1(49.53,58.3) 69.47,78.24
  Top Layer w0.381: v1(85.26,78.27) 85.26,76.92 D18.1
  Bottom Layer w0.203: v1(49.53,58.3) v1(42.93,51.69) ; v1(85.26,78.27) v1(69.46,78.27)
BOOT0: length 21.5
  Top Layer w0.203: v1(19.05,35.82) 22.74,35.82 U31.138
  Bottom Layer w0.203: v1(19.05,35.82) 15.42,39.45 BOOT0.1
BOOT1: length 6.6
  Top Layer w0.203: 37.72,56.77 40.16,56.77 U31.48
  vias: v1(37.77,56.83)
D+: length 4.8
  Bottom Layer w0.254: USB1.6 5.97,68.72 5.84,68.84 5.84,69.41 6.14,69.72 USB1.8 6.83,69.73 v1(8.87,69.73)
D-: length 3.7
  Bottom Layer w0.254: 7.75,68.47 7.5,68.22 USB1.5 ; 7.75,68.47 7.75,68.46 v1(8.87,68.46) ; 7.75,68.47 7.75,68.97 7.49,69.22 6.82,69.22 USB1.7
ESP_IO0: length 35.4
  Top Layer w0.203: v1(40.26,10.13) 38.89,8.77 27.81,8.77 26.67,9.91 v1(26.67,15.59) ; C52.1 27.31,15.62 27.31,15.63 R80.1
  Bottom Layer w0.203: U30.12 v1(40.26,10.13)
ESP_RST: length 12.7
  Top Layer w0.203: v1(37.66,2.13) 35.07,2.13 ; 35.07,2.13 30.91,2.13 30.16,2.88 C53.1 ; 35.07,2.13 33.11,4.09 v1(33.11,6.13)
ESP_RX0: length 11.6
  Top Layer w0.203: v1(52.76,4.13) 55.5,6.87 55.5,12.92 56.65,14.07 R76.1
ESP_RX0_E: length 15.1
  Inner2 w0.381: 57.53,18.93 58.93,20.32 60.96,20.32 62.61,18.67 62.61,12.45 63.5,11.56 64.64,11.56 H10.2
ESP_SPI_CLK:
  vias: v1(37.08,10.04)
ESP_SPI_CS:
  vias: v1(52.93,14.1)
ESP_SPI_MISO:
  vias: v1(37.12,12.07)
ESP_SPI_MOSI:
  vias: v1(37.13,14.1)
ESP_TX0: length 4.5
  Top Layer w0.203: v1(52.76,2.13) 55.39,2.13 56.69,3.44 R85.1
ESP_TX0_E: length 8.6
  Inner2 w0.381: 57.53,8.39 58.8,7.12 62.74,7.12 H10.1
FSMC_A0: length 53.7
  Top Layer w0.203: U31.10 34.54,46.95 v1(34.54,46.99) ; v1(53.21,76.84) 54.74,78.36 54.74,85.34 54.03,86.04
  Bottom Layer w0.203: v1(34.54,46.99) 32.89,48.64 32.89,50.93 53.21,71.25 v1(53.21,76.84)
FSMC_A1: length 53.8
  Top Layer w0.203: v1(53.97,76.84) 55.25,78.11 55.25,85.96 U13.4 ; v1(35.31,46.99) 35.31,46.9 U31.11
  Bottom Layer w0.203: v1(53.97,76.84) 53.97,71.25 33.4,50.68 33.4,48.9 v1(35.31,46.99)
FSMC_A2: length 54.4
  Top Layer w0.203: v1(35.26,47.93) 35.81,47.38 35.81,47.1 U31.12 ; U13.3 56.37,85.96 56.37,78.47 v1(54.74,76.84)
  Bottom Layer w0.203: v1(54.74,76.84) 54.74,71.38 33.91,50.55 33.91,49.28 v1(35.26,47.93)
FSMC_A3: length 54.6
  Top Layer w0.203: v1(55.5,76.84) 56.9,78.24 56.9,86.57 55.73,87.74 ; v1(36.32,47.76) 36.32,47.3 38.84,44.78
  Bottom Layer w0.203: v1(36.32,47.76) 34.42,49.66 34.42,50.42 55.5,71.5 v1(55.5,76.84)
FSMC_A4: length 54.3
  Top Layer w0.203: v1(56.26,76.84) 57.4,77.98 57.4,87.19 U13.1 ; v1(36.19,48.64) 37.85,46.99 37.85,46.49 39.19,45.14 39.19,45.13
  Bottom Layer w0.203: v1(36.19,48.64) 35.43,49.41 35.43,50.85 56.26,71.67 v1(56.26,76.84)
